# EasyEDA Pro project Zero_PCB_JLCEDA.eprj, board Zero_PCB
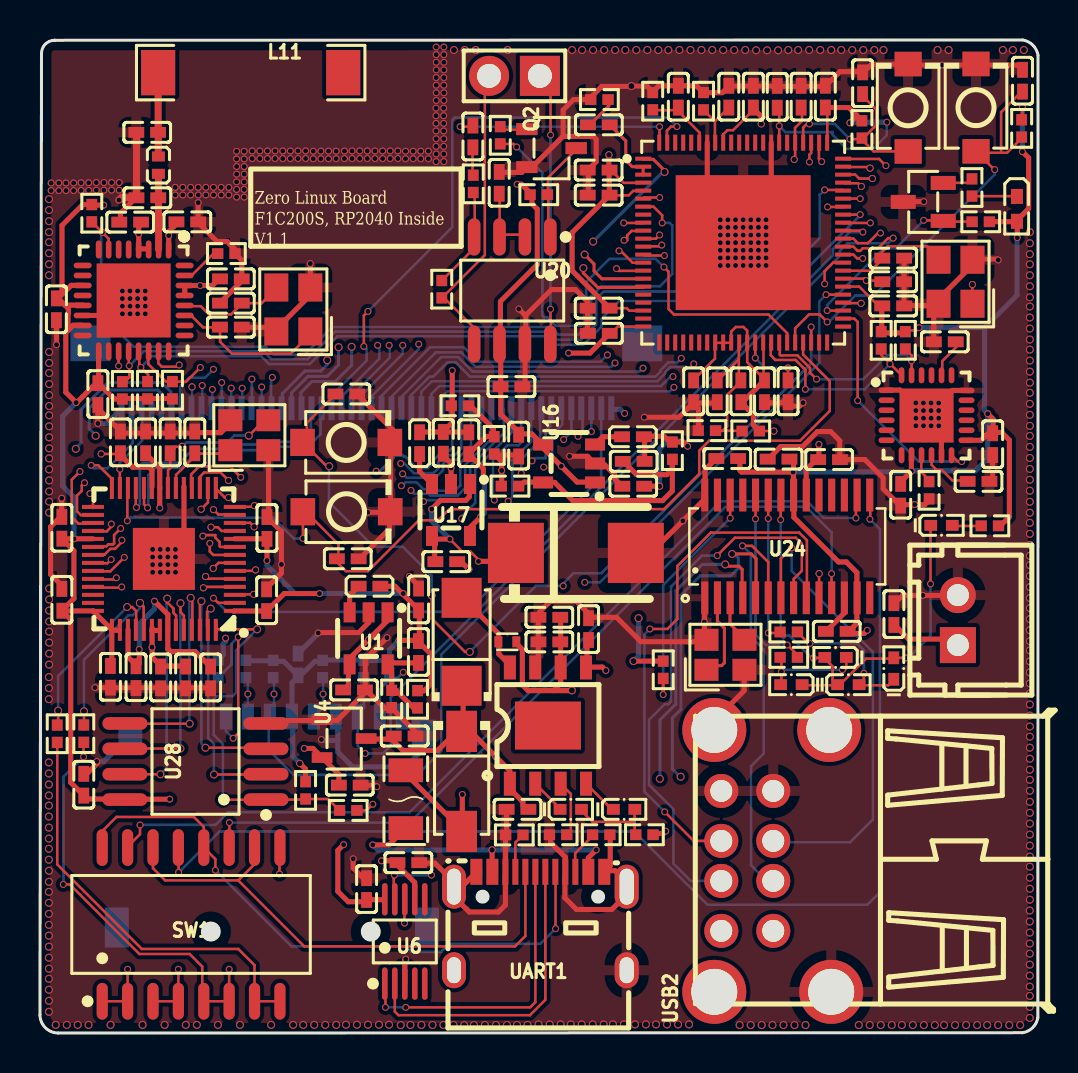
[diagram p1: board, top side]
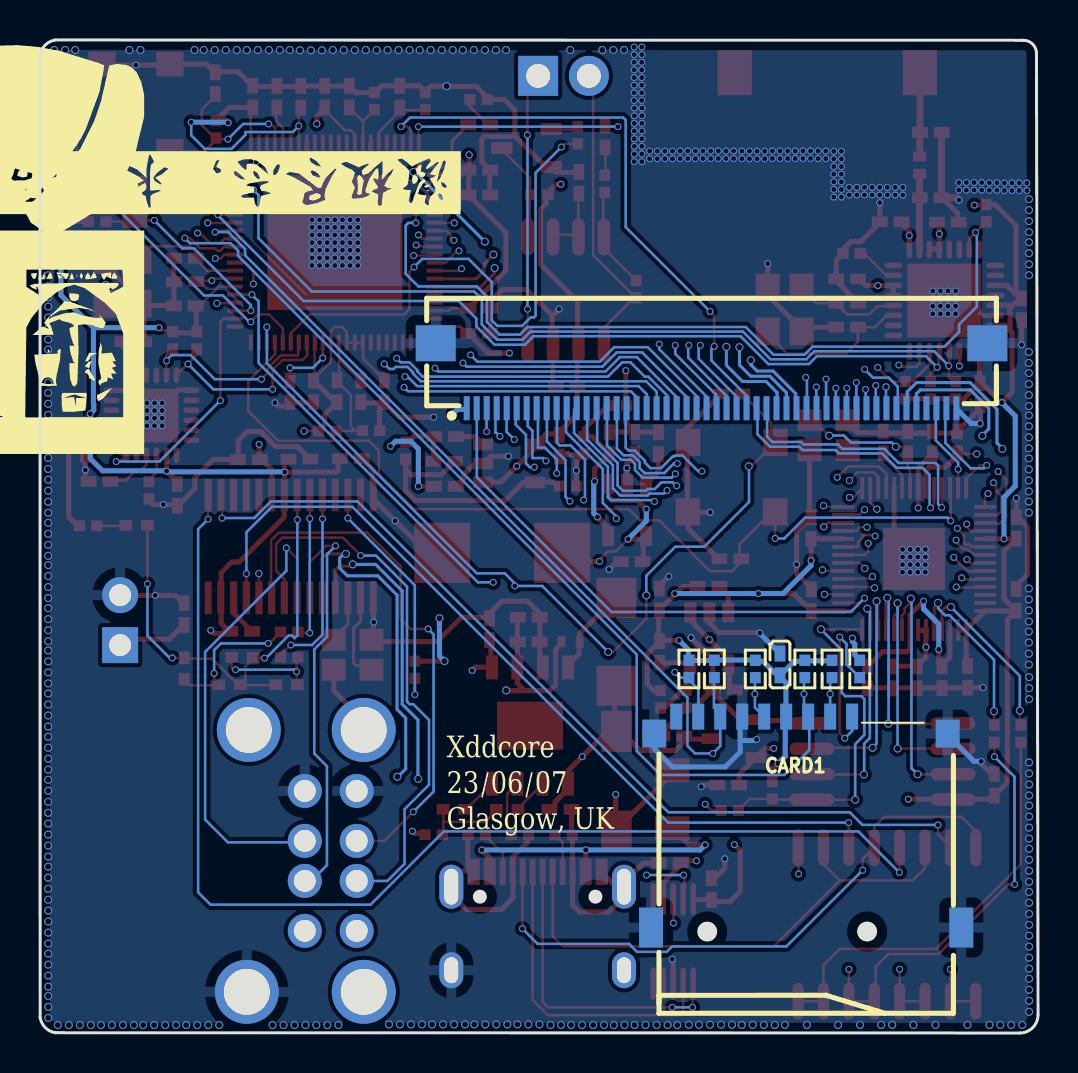
[diagram p2: board, bottom side, seen from below]

Outline 49.93 x 49.68 mm; copper layers: Top Layer, In1.Cu, In2.Cu, Bottom Layer. Coordinates in mm from the lower left corner of the outline.
Outline path: 0,0.92 0.08,49.01 arc(0.27,49.47) 0.73,49.66 49.16,49.68 arc(49.67,49.42) 49.93,48.91 49.92,0.78 arc(49.67,0.27) 49.16,0.01 0.92,0 arc(0.27,0.27) 0,0.92
Stack: Top Layer 0.035mm / dielectric 1 0.48mm FR4 er 4.5 / In1.Cu 0.035mm / dielectric 2 0.48mm FR4 er 4.5 / In2.Cu 0.035mm / dielectric 3 0.48mm FR4 er 4.5 / Bottom Layer 0.035mm

## Design rules (mm)
net +5V: Power
net GND: Power
net +3V3: Power
net +1V1: Power
net VBUS: Power
net +5VD: Power
net +2V5: Power
net +3V0: Power
net $1N27959: Signal
net $1N28302: Signal
net VBAT: Power
net USART0_RX: Signal
net USART0_TX: Signal
net $1N21711: Signal
net D+: Signal
net D-: Signal
net $1N21714: Signal
net TYPEC_DP: Signal
net TYPEC_DM: Signal
net $1N51517: Signal
net $1N51543: Signal
net $1N51512: Signal
net $1N51674: Signal
net $1N28696: Signal
net $1N28688: Signal
net $1N32222: Signal
net $1N32220: Signal
net $1N51525: Signal
net AMP_HPR: Signal
net WIFI_INT: Signal
net WIFI_RESET: Signal
net USART1_RX: Signal
net USART1_TX: Signal
net $1N53264: Signal
net I2C0_SDA: Signal
net I2C0_SCL: Signal
net KEY1: Signal
net LCD_BL: Signal
net LCD_RESET: Signal
net LCD_D/C: Signal
net STATUS_LED: Signal
net $1N53710: Signal
net $1N53734: Signal
net SD_D2: Signal
net SD_D3: Signal
net SD_CMD: Signal
net SD_CLK: Signal
net SD_D0: Signal
net SD_D1: Signal
net SPI0_CLK: Signal
net SPI0_CS: Signal
net SPI0_MISO: Signal
net SPI0_MOSI: Signal
net SPI1_MISO: Signal
net SPI1_CLK: Signal
net SPI1_MOSI: Signal
net SPI1_CS: Signal
net F1C200S_DM: Signal
net F1C200S_DP: Signal
net RESET: Signal
net $1N54475: Signal
net MIC_IN: Signal
net $1N54438: Signal
net RP2040_USB_D+: Signal
net RP2040_USB_D-: Signal
net USBHUB_DP: Signal
net USBHUB_DM: Signal
net USB1_D+: Signal
net USB1_D-: Signal
net $1N55245: Signal
net $1N55371: Signal
net $1N57526: Signal
net $1N57748: Signal
net $1N57843: Signal
net $1N57983: Signal
net $1N57974: Signal
net $1N57514: Signal
net $1N57804: Signal
net $1N59147: Signal
net $1N60452: Signal
net $1N60445: Signal
net $1N60101: Signal
net $1N60619: Signal
net $1N60746: Signal
net $1N60867: Signal
net $1N62198: Signal
net $1N62206: Signal
net USB3_D-: Signal
net USB3_D+: Signal
net AMP_EN: Signal
net RUN: Signal
net USB_BOOT: Signal
net USB2_D-: Signal
net USB2_D+: Signal
net LED4: Signal
net LED1: Signal
net LED2: Signal
net GPIO0: Signal
net GPIO1: Signal
net GPIO2: Signal
net GPIO3: Signal
net GPIO4: Signal
net GPIO5: Signal
net GPIO6: Signal
net GPIO7: Signal
net GPIO8: Signal
net GPIO9: Signal
net GPIO10: Signal
net GPIO11: Signal
net GPIO12: Signal
net GPIO13: Signal
net GPIO14: Signal
net GPIO15: Signal
net GPIO16: Signal
net GPIO17: Signal
net GPIO18: Signal
net GPIO19: Signal
net GPIO20: Signal
net GPIO21: Signal
net GPIO22: Signal
net GPIO23: Signal
net GPIO24: Signal
net GPIO25: Signal
net GPIO26_ADC0: Signal
net GPIO27_ADC1: Signal
net XIN: Signal
net XOUT: Signal
net SWCLK: Signal
net SWD: Signal
net $1N77680: Signal
net $1N77675: Signal
net QSPI_SCLK: Signal
net QSPI_SD0: Signal
net QSPI_SS: Signal
net QSPI_SD1: Signal
net QSPI_SD2: Signal
net QSPI_SD3: Signal
net $1N83735: Signal
net $1N78743: Signal
net $1N78675: Signal
net I2C1_SCL: Signal
net I2C1_SDA: Signal
template: 自定义配置
spacing copperThickness1oz (default): track to track 0.102, other pairs 0.152 to 0.3
spacing copperThickness2oz: track to track 0.203, other pairs 0.152 to 0.3
spacing copperThicknessInner0.5oz: track to track 0.089, other pairs 0.152 to 0.3
track width Signal (default): min 0.102, default 0.127, max 2.54
track width Power: min 0.102, default 0.254, max 2.54
differential pair differentialPair (default): width min 0.127, default 0.254, max 2.54; gap min 0.152, default 0.152
via viaSize (default): diameter min 0.3, default 0.61, max 10; hole min 0.201, default 0.305, max 6.299
net class Power uses Power
net +5V uses Power
net GND uses Power
net +3V3 uses Power
net +1V1 uses Power
net VBUS uses Power
net +5VD uses Power
net +2V5 uses Power
net +3V0 uses Power
net VBAT uses Power

## Placement (name value [footprint] x y rotation side)
C79  100nF  [C0402]  18.43 8.52 180 top
C80  100nF  [C0402]  16.34 7.2 90 top
C82  10uF  [C0402]  15.71 17.16 180 top
C83  20pF  [C0402]  18.93 19.06 90 top
C84  10uF  [C0402]  18.94 21.69 270 top
C85  10uF  [C0402]  23.95 29.39 90 top
C86  20pF  [C0402]  29.7 28.6 0 top
C87  10uF  [C0402]  29.68 27.35 0 top
C88  10uF  [C0402]  20.33 23.58 180 top
C89  20pF  [C0402]  21.45 29.51 90 top
C90  10uF  [C0402]  20.18 29.52 90 top
C91  1uF  [C0402]  18.25 14.86 0 top
C92  1uF  [C0402]  15.5 12.4 0 top
C93  10uF  [C0402]  27.45 20.21 270 top
C94  100nF  [C0402]  23.89 11.19 0 top
C95  220uF  [CASE-D_7343]  26.81 24.02 180 top
C96  100nF  [C0402]  42.72 20.96 270 top
C97  22uF  [C0402]  25.48 19.57 0 top
C98  22uF  [C0402]  25.48 20.8 0 top
C99  100nF  [C0402]  27.95 43.17 0 top
C100  100nF  [C0402]  27.95 41.92 0 top
C101  100nF  [C0402]  27.95 36.26 180 top
C102  100nF  [C0402]  27.96 35 180 top
C103  100nF  [C0402]  32.7 32.1 90 top
C104  100nF  [C0402]  36.25 32.1 90 top
C105  100nF  [C0402]  33.89 32.1 90 top
C106  100nF  [C0402]  35.07 32.1 90 top
C107  100nF  [C0402]  37.43 32.1 90 top
C108  100nF  [C0402]  42.69 36.38 180 top
C109  18pF  [C0402]  42.69 38.76 180 top
C110  18pF  [C0402]  42.69 37.58 0 top
C111  100nF  [C0402]  39.29 46.84 270 top
C112  100nF  [C0402]  38.08 46.84 270 top
C113  100nF  [C0402]  36.89 46.83 270 top
C114  100nF  [C0402]  35.69 46.84 270 top
C115  1uF  [C0402]  34.46 46.84 270 top
C116  1uF  [C0402]  31.94 46.84 270 top
C117  100nF  [C0402]  41.16 47.52 90 top
C118  100nF  [C0402]  49.16 47.64 90 top
C120  10uF  [C0402]  4.51 40.57 180 top
C121  100nF  [C0402]  7.37 40.58 0 top
C122  1uF  [C0402]  23.59 32.34 180 top
C123  1uF  [C0402]  22.98 42.53 270 top
C124  390nF  [C0402]  21.66 44.85 270 top
C125  3pF  [C0402]  5.37 41.79 0 top
C127  2.4pF  [C0402]  5.37 45.06 0 top
C128  100nF  [C0402]  0.82 36.21 90 top
C129  100nF  [C0402]  2.9 31.96 90 top
C130  10pF  [C0402]  9.55 35.31 180 top
C131  10pF  [C0402]  9.55 36.51 180 top
C132  100nF  [C0402]  9.55 37.73 0 top
C133  10nF  [C0402]  43.06 26.93 270 top
C134  100nF  [C0402]  46.96 27.6 180 top
C135  2.2nF  [C0402]  45.27 34.58 180 top
C136  100nF  [C0402]  47.66 29.46 90 top
C137  100nF  [C0402]  12.91 18.44 90 bottom
C139  1uF  [C0402]  39.86 20.09 0 top
C140  1uF  [C0402]  39.48 28.69 0 top
C141  10uF  [C0402]  34.38 28.74 180 top
C142  100nF  [C0402]  36.95 28.71 180 top
C146  100nF  [C0402]  2.19 12.42 90 top
C147  27pF  [C0402]  7.74 29.55 90 top
C148  27pF  [C0402]  6.51 29.55 270 top
C149  100nF  [C0402]  15.33 31.97 180 top
C150  100nF  [C0402]  15.4 23.72 180 top
C151  100nF  [C0402]  4.02 29.55 90 top
C152  100nF  [C0402]  8.54 17.79 270 top
C153  100nF  [C0402]  6.04 17.79 270 top
C154  100nF  [C0402]  1.09 21.67 90 top
C155  100nF  [C0402]  1.09 25.28 90 top
C156  100nF  [C0402]  11.34 21.65 90 top
C157  100nF  [C0402]  5.28 29.55 90 top
C158  100nF  [C0402]  11.36 25.27 90 top
C159  100nF  [C0402]  7.29 17.79 270 top
C160  1uF  [C0402]  3.53 17.82 90 top
C161  1uF  [C0402]  4.81 17.8 90 top
C162  100nF  [C0402]  27.96 45.44 0 top
CARD1  TF-01A  [TF-SMD_TF-01A]  11.6 10.55 180 bottom
D1  SS54  [SMA_L4.4-W2.8-LS5.4-R-RD]  21.1 12.59 270 top
D11  SS32  [SMA_L4.3-W2.6-LS5.2-RD]  21.1 19.57 90 top
F1  Fuse  [F1206]  18.3 11.7 270 top
FPC1  FPC-05FB-50PH20  [FPC-SMD_50P-P0.50_FPC-05FB-50PH20]  16.33 32.88 0 bottom
H1  PZ254V-11-02P  [HDR-TH_2P-P2.54-V-M]  23.74 47.88 180 top
J1  Conn_01x02  [CONN-TH_2P-P2.50_HX25003-2A]  45.92 20.66 90 top
L5  2.2uH  [L0402]  16.49 22.35 0 top
L6  2.2uH  [L0402]  29.67 29.83 0 top
L7  2.2uH  [L0402]  18.99 29.51 90 top
L8  10uH  [IND-SMD_L1.0-W0.5-2]  23.38 19.57 180 top
L10  2.2nH  [IND-SMD_L1.0-W0.6]  5.93 43.42 270 top
L11  AN9520-245  [ANT-SMD_L9.5-W2.1]  10.54 48.04 0 top
LED1  NCD0402R1  [LED0402-RD]  26.56 11.19 0 top
LED2  XL-1005UGC  [LED0402-RD_GREEN]  29.22 11.19 0 top
LED3  NCD0402B1  [LED0402-R-RD]  48.88 41.23 270 top
LED4  XL-1005UGC  [LED0402-RD_GREEN]  45.11 25.4 0 top
LED5  XL-1005UGC  [LED0402-RD_GREEN]  37.59 17.43 180 top
LED6  XL-1005UGC  [LED0402-RD_GREEN]  39.8 18.79 180 top
LED7  XL-1005UGC  [LED0402-RD_GREEN]  40.45 17.43 0 top
LED8  XL-1005UGC  [LED0402-RD_GREEN]  42.72 18.23 90 top
Q1  2N7002  [SOT-23-3_L2.9-W1.3-P1.90-LS2.4-BR]  44.19 41.58 0 top
Q2  S8050  [SOT-23-3_L2.9-W1.6-P1.90-LS2.8-BR]  25.59 44.27 180 top
R58  2.2kΩ  [R0402]  23.73 9.91 180 top
R59  2.2kΩ  [R0402]  28.08 9.92 180 top
R60  680kΩ  [R0402]  18.89 16.7 90 top
R61  150kΩ  [R0402]  17.6 16.71 90 top
R62  470kΩ  [R0402]  31.64 29.13 90 top
R63  150kΩ  [R0402]  23.51 27.36 0 top
R64  150kΩ  [R0402]  21.01 31.38 180 top
R65  150kΩ  [R0402]  22.73 29.4 90 top
R66  1.1kΩ  [R0402]  25.92 9.92 0 top
R67  1kΩ  [R0402]  30.24 9.92 180 top
R68  2.2kΩ  [R0402]  35.56 30.12 180 top
R69  2.2kΩ  [R0402]  33.37 30.14 180 top
R70  200kΩ  [R0402]  33.2 46.62 270 top
R71  200kΩ  [R0402]  30.66 46.62 270 top
R72  49.9kΩ  [R0402]  41.12 45.2 270 top
R73  49.9kΩ  [R0402]  49.11 45.25 270 top
R74  3.3kΩ  [R0402]  46.63 42.3 270 top
R75  49.9kΩ  [R0402]  47.07 40.59 0 top
R76  10kΩ  [R0402]  24.95 41.94 180 top
R77  1kΩ  [R0402]  23.03 44.91 270 top
R78  20kΩ  [R0402]  21.68 42.48 270 top
R79  20kΩ  [R0402]  20.1 37.21 270 top
R80  10kΩ  [R0402]  2.59 41.01 270 top
R81  10kΩ  [R0402]  4.13 32.15 90 top
R82  10kΩ  [R0402]  5.38 32.15 90 top
R83  12kΩ  [R0402]  9.33 38.99 0 top
R84  10kΩ  [R0402]  6.63 32.16 90 top
R85  10kΩ  [R0402]  44.48 27.15 90 top
R86  4.7kΩ  [R0402]  42.09 34.65 90 top
R87  4.7kΩ  [R0402]  43.29 34.65 90 top
R88  10kΩ  [R0402]  16.19 18.21 90 bottom
R89  10kΩ  [R0402]  17.47 18.21 90 bottom
R90  10kΩ  [R0402]  8.92 18.21 90 bottom
R91  10kΩ  [R0402]  10.31 18.21 90 bottom
R92  10kΩ  [R0402]  11.67 18.21 270 bottom
R93  10kΩ  [R0402]  14.14 18.21 270 bottom
R100  10kΩ  [R0402]  13.29 12.14 90 top
R101  1kΩ  [R0402]  15.42 11.14 180 top
R102  27Ω  [R0402]  2.19 14.98 270 top
R103  27Ω  [R0402]  0.86 14.97 270 top
R104  220Ω  [R0402]  37.46 18.79 180 top
R105  220Ω  [R0402]  37.46 20.06 0 top
R106  470Ω  [R0402]  47.52 25.37 0 top
R107  22Ω  [R0402]  27.99 46.7 0 top
R108  10kΩ  [R0402]  31.18 18.17 90 top
SW1  DSHP08TS-S  [SW-SMD_DSHP08TS-S]  7.56 5.43 0 top
SW2  TS-1088-AR02016  [SW-SMD_L3.9-W3.0-P4.45]  43.43 46.29 90 top
SW3  TS-1088-AR02016  [SW-SMD_L3.9-W3.0-P4.45]  46.83 46.29 90 top
SW4  TS-1088-AR02016  [SW-SMD_L3.9-W3.0-P4.45]  15.32 29.55 0 top
SW5  TS-1088-AR02016  [SW-SMD_L3.9-W3.0-P4.45]  15.34 26.08 0 top
U1  SY8088AAC  [SOT-23-5_L3.0-W1.7-P0.95-LS2.8-BR]  16.44 19.74 90 top
U4  XC6206P302MR  [SOT-23-3_L3.0-W1.7-P0.95-LS2.9-BR]  15.22 14.73 180 top
U5  TP5400  [ESOP-8_L4.9-W3.9-P1.27-LS6.0-BL-EP]  25.41 15.38 0 top
U6  CH340E  [MSOP-10_L3.0-W3.0-P0.50-LS5.0-BL]  18.25 4.58 0 top
U16  SY8088AAC  [SOT-23-5_L3.0-W1.7-P0.95-LS2.8-BR]  26.47 28.49 0 top
U17  SY8088AAC  [SOT-23-5_L3.0-W1.7-P0.95-LS2.8-BR]  20.56 26.17 90 top
U18  F1C200S  [QFN-88_L10.0-W10.0-P0.40-BL-EP6.75]  35.18 39.54 270 top
U19  24MHz  [CRYSTAL-SMD_4P-L3.2-W2.5-BL]  45.8 37.58 90 top
U20  LM4871DRG  [SOP-8_L4.9-W3.9-P1.27-LS6.0-BL]  23.63 37.14 180 top
U22  ESP8266EX  [QFN-32_L5.0-W5.0-P0.50-BL-EP3.7]  4.69 36.65 180 top
U23  MPU-6050  [QFN-24_L4.0-W4.0-P0.50-BL-EP2.7]  44.36 30.9 270 top
U24  CH334U  [QSOP-28_L9.9-W3.9-P0.64-LS6.0-BL]  37.39 24.34 0 top
U25  RP2040  [LQFN-56_L7.0-W7.0-P0.4-EP]  6.2 23.72 180 top
U28  W25Q128JVSIQ  [SOIC-8_L5.3-W5.3-P1.27-LS8.0-BL]  7.78 13.58 90 top
UART1  USB_C  [USB-3.1-SMD_U262-161N-4BVC11]  25.03 5.6 0 top
USB2  907-112A1012D10200  [USB-A-TH_USB-M-51]  36.66 8.61 90 top
X1  26MHz  [CRYSTAL-SMD_4P-L3.2-W2.5-BL]  12.68 36.2 90 top
X2  -  [OSC-SMD_4P-L2.5-W2.0-BL]  10.48 29.91 0 top
X3  -  [OSC-SMD_4P-L2.5-W2.0-BL]  34.3 18.92 0 top

## Footprints (pads in the part's own frame, mm; a bottom-side part is the same pattern mirrored in y, then rotated)
ANT-SMD_L9.5-W2.1
  rect 1.71x2.268 smd: 1(-4.63,0) 2(4.63,0)
C0402
  rect 0.79x0.54 smd: 1(-0.545,0) 2(0.545,0)
CASE-D_7343
  rect 2.799x3.01 smd: 1(3,0) 2(-3,0)
CONN-TH_2P-P2.50_HX25003-2A
  rect 1.8x1.8 hole 1.1: 1(-1.25,0)
  round 1.8 hole 1.1: 2(1.25,0)
CRYSTAL-SMD_4P-L3.2-W2.5-BL
  rect 1.4x1.2 smd: 1(-1.1,-0.85) 2(1.1,-0.85) 3(1.1,0.85) 4(-1.1,0.85)
ESOP-8_L4.9-W3.9-P1.27-LS6.0-BL-EP
  rect 0.6x1.2 smd: 1(-1.905,-2.909) 2(-0.635,-2.909) 3(0.635,-2.909) 4(1.905,-2.909) 5(1.905,2.909) 6(0.635,2.909) 7(-0.635,2.909) 8(-1.905,2.909)
  rect 3.3x2.4 smd: 9(0,0)
F1206
  rect 1.19x1.728 smd: 1(-1.445,0) 2(1.445,0)
FPC-SMD_50P-P0.50_FPC-05FB-50PH20
  rect 0.3x1.2 smd: 1(12.25,1.625) 2(11.75,1.625) 3(11.25,1.625) 4(10.75,1.625) 5(10.25,1.625) 6(9.75,1.625) 7(9.25,1.625) 8(8.75,1.625) 9(8.25,1.625) 10(7.75,1.625) 11(7.25,1.625) 12(6.75,1.625) 13(6.25,1.625) 14(5.75,1.625) 15(5.25,1.625) 16(4.75,1.625) 17(4.25,1.625) 18(3.75,1.625) 19(3.25,1.625) 20(2.75,1.625) 21(2.25,1.625) 22(1.75,1.625) 23(1.25,1.625) 24(0.75,1.625) 25(0.25,1.625) 26(-0.25,1.625) 27(-0.75,1.625) 28(-1.25,1.625) 29(-1.75,1.625) 30(-2.25,1.625) 31(-2.75,1.625) 32(-3.25,1.625) 33(-3.75,1.625) 34(-4.25,1.625) 35(-4.75,1.625) 36(-5.25,1.625) 37(-5.75,1.625) 38(-6.25,1.625) 39(-6.75,1.625) 40(-7.25,1.625) 41(-7.75,1.625) 42(-8.25,1.625) 43(-8.75,1.625) 44(-9.25,1.625) 45(-9.75,1.625) 46(-10.25,1.625) 47(-10.75,1.625) 48(-11.25,1.625) 49(-11.75,1.625) 50(-12.25,1.625)
  rect 2x1.8 smd: 51(-13.8,-1.625) 52(13.8,-1.625)
HDR-TH_2P-P2.54-V-M
  rect 2x2 hole 1.2: 1(-1.27,0)
  round 2 hole 1.2: 2(1.27,0)
IND-SMD_L1.0-W0.5-2
  rect 0.4x0.55 smd: 1(-0.45,0) 2(0.45,0)
IND-SMD_L1.0-W0.6
  rect 0.5x0.648 smd: 1(-0.434,0) 2(0.434,0)
L0402
  rect 0.79x0.54 smd: 1(-0.545,0) 2(0.545,0)
LED0402-R-RD
  rect 0.75x0.6 smd: 1(0.623,0) 2(-0.623,0)
LED0402-RD
  rect 0.636x0.54 smd: 1(-0.538,0) 2(0.538,0)
LED0402-RD_GREEN
  rect 0.636x0.54 smd: 1(-0.538,0) 2(0.538,0)
LQFN-56_L7.0-W7.0-P0.4-EP
  rect 1.1x0.2 smd: 1(-3.55,2.6) 2(-3.55,2.2) 3(-3.55,1.8) 4(-3.55,1.4) 5(-3.55,1) 6(-3.55,0.6) 7(-3.55,0.2) 8(-3.55,-0.2) 9(-3.55,-0.6) 10(-3.55,-1) 11(-3.55,-1.4) 12(-3.55,-1.8) 13(-3.55,-2.2) 14(-3.55,-2.6) 29(3.55,-2.6) 30(3.55,-2.2) 31(3.55,-1.8) 32(3.55,-1.4) 33(3.55,-1) 34(3.55,-0.6) 35(3.55,-0.2) 36(3.55,0.2) 37(3.55,0.6) 38(3.55,1) 39(3.55,1.4) 40(3.55,1.8) 41(3.55,2.2) 42(3.55,2.6)
  rect 0.2x1.1 smd: 15(-2.6,-3.55) 16(-2.2,-3.55) 17(-1.8,-3.55) 18(-1.4,-3.55) 19(-1,-3.55) 20(-0.6,-3.55) 21(-0.2,-3.55) 22(0.2,-3.55) 23(0.6,-3.55) 24(1,-3.55) 25(1.4,-3.55) 26(1.8,-3.55) 27(2.2,-3.55) 28(2.6,-3.55) 43(2.6,3.55) 44(2.2,3.55) 45(1.8,3.55) 46(1.4,3.55) 47(1,3.55) 48(0.6,3.55) 49(0.2,3.55) 50(-0.2,3.55) 51(-0.6,3.55) 52(-1,3.55) 53(-1.4,3.55) 54(-1.8,3.55) 55(-2.2,3.55) 56(-2.6,3.55)
  rect 3.1x3.1 smd: 57(0,0)
MSOP-10_L3.0-W3.0-P0.50-LS5.0-BL
  oval 0.28x1.62 smd: 1(-1,-2.11) 2(-0.5,-2.11) 3(0,-2.11) 4(0.5,-2.11) 5(1,-2.11) 6(1,2.11) 7(0.5,2.11) 8(0,2.11) 9(-0.5,2.11) 10(-1,2.11)
OSC-SMD_4P-L2.5-W2.0-BL
  rect 1.2x1.1 smd: 1(-0.95,-0.75) 2(0.95,-0.75) 3(0.95,0.75) 4(-0.95,0.75)
QFN-24_L4.0-W4.0-P0.50-BL-EP2.7
  oval 0.28x0.8 smd: 1(-1.25,-2) 2(-0.75,-2) 3(-0.25,-2) 4(0.25,-2) 5(0.75,-2) 6(1.25,-2) 13(1.25,2) 14(0.75,2) 15(0.25,2) 16(-0.25,2) 17(-0.75,2) 18(-1.242,2)
  oval 0.8x0.28 smd: 7(2,-1.25) 8(2,-0.75) 9(2,-0.25) 10(2,0.25) 11(2,0.75) 12(2,1.25) 19(-2,1.25) 20(-2,0.75) 21(-2,0.25) 22(-2,-0.25) 23(-2,-0.75) 24(-2,-1.25)
  rect 2.7x2.7 smd: 25(0.013,0)
QFN-32_L5.0-W5.0-P0.50-BL-EP3.7
  oval 0.28x0.9 smd: 1(-1.75,-2.55) 2(-1.25,-2.55) 3(-0.75,-2.55) 4(-0.249,-2.55) 5(0.249,-2.55) 6(0.75,-2.55) 7(1.25,-2.55) 8(1.75,-2.55) 17(1.75,2.55) 18(1.25,2.55) 19(0.75,2.55) 20(0.249,2.55) 21(-0.249,2.55) 22(-0.75,2.55) 23(-1.25,2.55) 24(-1.75,2.55)
  oval 0.9x0.28 smd: 9(2.55,-1.75) 10(2.55,-1.25) 11(2.55,-0.75) 12(2.55,-0.249) 13(2.55,0.249) 14(2.55,0.75) 15(2.55,1.25) 16(2.55,1.75) 25(-2.55,1.75) 26(-2.55,1.25) 27(-2.55,0.75) 28(-2.55,0.249) 29(-2.55,-0.249) 30(-2.55,-0.75) 31(-2.55,-1.25) 32(-2.55,-1.75)
  rect 3.7x3.7 smd: 33(0,0)
QFN-88_L10.0-W10.0-P0.40-BL-EP6.75
  rect 0.2x0.8 smd: 1(-4.2,-5) 2(-3.8,-5) 3(-3.4,-5) 4(-3,-5) 5(-2.6,-5) 6(-2.2,-5) 7(-1.8,-5) 8(-1.4,-5) 9(-1,-5) 10(-0.6,-5) 11(-0.2,-5) 12(0.2,-5) 13(0.6,-5) 14(1,-5) 15(1.4,-5) 16(1.8,-5) 17(2.2,-5) 18(2.6,-5) 19(3,-5) 20(3.4,-5) 21(3.8,-5) 22(4.2,-5) 45(4.2,5) 46(3.8,5) 47(3.4,5) 48(3,5) 49(2.6,5) 50(2.2,5) 51(1.8,5) 52(1.4,5) 53(1,5) 54(0.6,5) 55(0.2,5) 56(-0.2,5) 57(-0.6,5) 58(-1,5) 59(-1.4,5) 60(-1.8,5) 61(-2.2,5) 62(-2.6,5) 63(-3,5) 64(-3.4,5) 65(-3.8,5) 66(-4.2,5)
  rect 0.8x0.2 smd: 23(5,-4.2) 24(5,-3.8) 25(5,-3.4) 26(5,-3) 27(5,-2.6) 28(5,-2.2) 29(5,-1.8) 30(5,-1.4) 31(5,-1) 32(5,-0.6) 33(5,-0.2) 34(5,0.2) 35(5,0.6) 36(5,1) 37(5,1.4) 38(5,1.8) 39(5,2.2) 40(5,2.6) 41(5,3) 42(5,3.4) 43(5,3.8) 44(5,4.2) 67(-5,4.2) 68(-5,3.8) 69(-5,3.4) 70(-5,3) 71(-5,2.6) 72(-5,2.2) 73(-5,1.8) 74(-5,1.4) 75(-5,1) 76(-5,0.6) 77(-5,0.2) 78(-5,-0.2) 79(-5,-0.6) 80(-5,-1) 81(-5,-1.4) 82(-5,-1.8) 83(-5,-2.2) 84(-5,-2.6) 85(-5,-3) 86(-5,-3.4) 87(-5,-3.8) 88(-5,-4.2)
  rect 6.75x6.75 smd: 89(0,0)
QSOP-28_L9.9-W3.9-P0.64-LS6.0-BL
  rect 0.355x1.64 smd: 1(-4.128,-2.57) 2(-3.493,-2.57) 3(-2.857,-2.57) 4(-2.223,-2.57) 5(-1.587,-2.57) 6(-0.953,-2.57) 7(-0.318,-2.57) 8(0.318,-2.57) 9(0.953,-2.57) 10(1.587,-2.57) 11(2.223,-2.57) 12(2.857,-2.57) 13(3.493,-2.57) 14(4.128,-2.57) 15(4.128,2.57) 16(3.493,2.57) 17(2.857,2.57) 18(2.223,2.57) 19(1.587,2.57) 20(0.953,2.57) 21(0.318,2.57) 22(-0.318,2.57) 23(-0.953,2.57) 24(-1.587,2.57) 25(-2.223,2.57) 26(-2.857,2.57) 27(-3.493,2.57) 28(-4.128,2.57)
R0402
  rect 0.566x0.54 smd: 1(-0.433,0) 2(0.433,0)
SMA_L4.3-W2.6-LS5.2-RD
  rect 2x2 smd: 1(-2.2,0) 2(2.2,0)
SMA_L4.4-W2.8-LS5.4-R-RD
  rect 2.062x1.539 smd: 1(2.503,0) 2(-2.503,0)
SOIC-8_L5.3-W5.3-P1.27-LS8.0-BL
  oval 0.63x2.25 smd: 1(-1.905,-3.53) 2(-0.635,-3.53) 3(0.635,-3.53) 4(1.905,-3.53) 5(1.905,3.53) 6(0.635,3.53) 7(-0.635,3.53) 8(-1.905,3.53)
SOP-8_L4.9-W3.9-P1.27-LS6.0-BL
  oval 0.63x1.865 smd: 1(-1.905,-2.683) 2(-0.635,-2.683) 3(0.635,-2.683) 4(1.905,-2.683) 5(1.905,2.683) 6(0.635,2.683) 7(-0.635,2.683) 8(-1.905,2.683)
SOT-23-3_L2.9-W1.3-P1.90-LS2.4-BR
  rect 1.25x0.7 smd: 1(1,-0.95) 2(1,0.95) 3(-1,0)
SOT-23-3_L2.9-W1.6-P1.90-LS2.8-BR
  rect 1.07x0.6 smd: 1(1.235,-0.95) 2(1.235,0.95) 3(-1.235,0)
SOT-23-3_L3.0-W1.7-P0.95-LS2.9-BR
  rect 1.038x0.532 smd: 1(1.101,-0.95) 2(1.101,0.95) 3(-1.101,0)
SOT-23-5_L3.0-W1.7-P0.95-LS2.8-BR
  rect 1x0.6 smd: 1(1.3,-0.95) 2(1.3,0) 3(1.3,0.95) 4(-1.3,0.95) 5(-1.3,-0.95)
SW-SMD_DSHP08TS-S
  oval 0.56x1.84 smd: 1(-4.445,-3.845) 2(-3.175,-3.845) 3(-1.905,-3.845) 4(-0.635,-3.845) 5(0.635,-3.845) 6(1.905,-3.845) 7(3.175,-3.845) 8(4.445,-3.845) 9(4.445,3.845) 10(3.175,3.845) 11(1.905,3.845) 12(0.635,3.845) 13(-0.635,3.845) 14(-1.905,3.845) 15(-3.175,3.845) 16(-4.445,3.845)
SW-SMD_L3.9-W3.0-P4.45
  rect 1.23x1.36 smd: 1(-2.185,0) 2(2.185,0)
TF-SMD_TF-01A
  rect 0.6x1.3 smd: 1(2.3,5.276) 2(1.2,5.276) 3(0.101,5.276) 4(-1,5.276) 5(-2.099,5.276) 6(-3.2,5.276) 7(-4.3,5.276) 8(-5.399,5.276) 9(-6.5,5.276)
  rect 1.2x1.4 smd: 10(-7.599,4.426) 13(7.08,4.426)
  rect 1.2x2 smd: 11(-7.76,-5.276) 12(7.76,-5.276)
USB-3.1-SMD_U262-161N-4BVC11
  rect 0.6x1.3 smd: A1B12(-3.2,2.462) A4B9(-2.4,2.462) B1A12(3.2,2.462) B4A9(2.4,2.462)
  rect 0.3x1.3 smd: A5(-1.25,2.462) A6(-0.25,2.462) A7(0.25,2.462) A8(1.25,2.462) B5(1.75,2.462) B6(0.75,2.462) B7(-0.75,2.462) B8(-1.75,2.462)
  oval 1.2x2.2 hole 0.7x1.8: SHELL(-4.32,1.719) SHELL(4.32,1.719)
  oval 1.2x1.8 hole 0.7x1.3: SHELL(-4.32,-2.462) SHELL(4.32,-2.462)
USB-A-TH_USB-M-51
  round 1.7 hole 1.1: 1(-3.5,2.575) 2(-1.001,2.575) 3(1.001,2.575) 4(3.5,2.575) 5(-3.5,-0.026) 6(-1.001,-0.026) 7(1.001,-0.026) 8(3.5,-0.026)
  round 3.2 hole 2.3: 9(-6.551,2.925) 9(-6.551,-2.925) 9(6.551,2.925) 9(6.551,-2.826)

## Nets
As in the schematic.

Pads without a net: CARD1 9; FPC1 47; L11 2; U5 9; U6 4 5 6; U18 8 18 19 21 23 24 25 26 27 28 29 43 44 45 72 75 76 77 78 79 84 85 86; U22 5 6 8 9 10 12 16 18 24 25 26 32; U23 2 3 4 5 6 7 14 15 16 17 19 21 22; U24 14 17 18 19 25 27; U25 40 41

## Via types
v1: diameter 0.35, hole 0.25, Top Layer to Bottom Layer, 520 vias
v2: diameter 0.4, hole 0.3, Top Layer to Bottom Layer, 284 vias

## Routing (per net, layer and track width the routed paths; a pad name or vN(x,y) marks a point on that pad's centre or on a via; arc(x,y) is an arc through that point)
+1V1: length 108.5
  Top Layer w0.127: 28.54,34.98 28.91,35.34 30.12,35.34 ; U18.71 37.78,43.75 v1(37.73,43.7) ; v1(35.79,33.77) 35.79,34.5 35.77,34.51 ; 38.12,46.18 38.12,45.63 37.78,45.28 37.78,44.77 ; v1(3.06,28.97) 3.97,28.97 ; v1(37.42,33.28) 37.42,32.68
  Top Layer w0.254: v1(26.45,34.02) 27.52,34.02 C102.1 ; 8.52,18.33 7.77,19.08 6.55,19.08 6.4,19.23 6.4,20.13 ; 20.18,30.1 20.63,30.54 v1(20.63,33.14) 20.62,33.13 ; 4.81,18.4 4.41,18.81 4.41,20.18 ; 5.6,27.32 5.6,28.16 5.46,28.31 4.64,28.31 3.98,28.96 ; v1(5.73,21.6) 6.4,20.93 U25.50 ; 21.46,30.07 19,30.07 18.97,30.04 ; v1(4.97,19.19) 4.97,18.51 C161.2
  In1.Cu w0.254: 26.45,39.15 31,43.7 v1(37.73,43.7) ; 26.45,34 26.45,39.14
  In2.Cu w0.127: v1(37.73,43.7) 37.73,45.73 38.88,46.88 39.64,46.88 40.02,46.5 40.02,44.51 40.22,44.3 42.34,44.3 43.19,43.45 43.19,39.64 42.94,39.38 42.81,39.38 41.92,38.5 41.92,36.72 38.48,33.28 v1(37.42,33.28)
  In2.Cu w0.254: v1(5.73,21.6) 5.48,21.35 5.48,21.23 5.02,20.77 3.64,20.77 3.06,21.35 v1(3.06,28.97) 5.19,31.1 18.58,31.1 v1(20.63,33.14) 25.57,33.14 v1(26.45,34.02)
  Bottom Layer w0.127: v1(37.42,33.28) 36.28,33.28 v1(35.79,33.77)
  Bottom Layer w0.254: v1(5.73,21.6) 5.73,21.22 4.97,20.46 v1(4.97,19.19)
+2V5: length 25.6
  Top Layer w0.127: 33.79,34.53 34.59,34.53 ; 35.38,34.53 35.38,33.56 36.2,32.75 ; 32.73,32.7 33.77,33.74 33.77,34.38 ; U18.32 34.58,35.09 34.81,35.32 35.19,35.32 35.38,35.13 U18.34 ; 36.2,32.75 36.2,32.69 36.19,32.68 ; 36.2,32.75 36.35,32.6 ; 36.2,32.75 36.2,34.51 ; v1(36.72,30.11) 36.71,30.12 R68.1
  Top Layer w0.254: C86.2 30.25,29.83 30.22,29.85 31.22,29.85 31.59,29.48 ; 36.15,32.47 36.06,32.47 35.27,31.68 ; C87.2 v1(31,27.35) ; v1(32.4,29.35) 32.19,29.56 R62.2 ; 36.11,30 35.69,30.42 35.69,30.93 35.24,31.38 35.24,31.5
  In2.Cu w0.127: v1(32.4,29.35) 35.96,29.35 v1(36.72,30.11)
  Bottom Layer w0.254: v1(32.4,29.35) 32.15,29.61 31.38,29.61 31,29.22 v1(31,27.35)
+3V0: length 63.5
  Top Layer w0.127: 34.18,44.65 34.18,44.95 34.39,45.17 34.68,45.17 35.72,46.21 35.78,46.27
  Top Layer w0.254: 35.72,46.21 36.08,45.86 v1(36.08,45.48) ; v1(13.22,14.24) 13.66,14.24 U4.2 14.95,12.94 C92.1
  In2.Cu w0.254: v1(13.22,14.24) 13.98,13.48 16.64,13.48 29.98,26.81 31.26,26.81 32.65,28.21 35.57,28.21 43.58,36.21 43.58,43.72 39.91,47.39 37.99,47.39 v1(36.08,45.48)
+3V3: length 298.6
  Top Layer w0.127: v1(43.98,35.29) 43.84,35.15 43.38,35.15 ; 28.52,41.91 29.45,41.91 29.68,42.13 30.19,42.13 ; 36.98,44.64 36.99,44.65 v1(36.99,45.38) 36.99,46.31 ; 28.52,36.26 29.35,36.26 29.48,36.14 29.99,36.14 ; 49.17,45.62 49.15,45.64 v1(49.15,46.34) ; 39.39,44.55 39.39,46.16 39.31,46.24 ; 42.06,36.28 42.04,36.28 40.99,37.34 U18.50 ; 28.64,43.09 29.2,42.53 30.05,42.53